# EasyEDA Pro project E33_Panel_2023.9.26.eprj, board PCB1
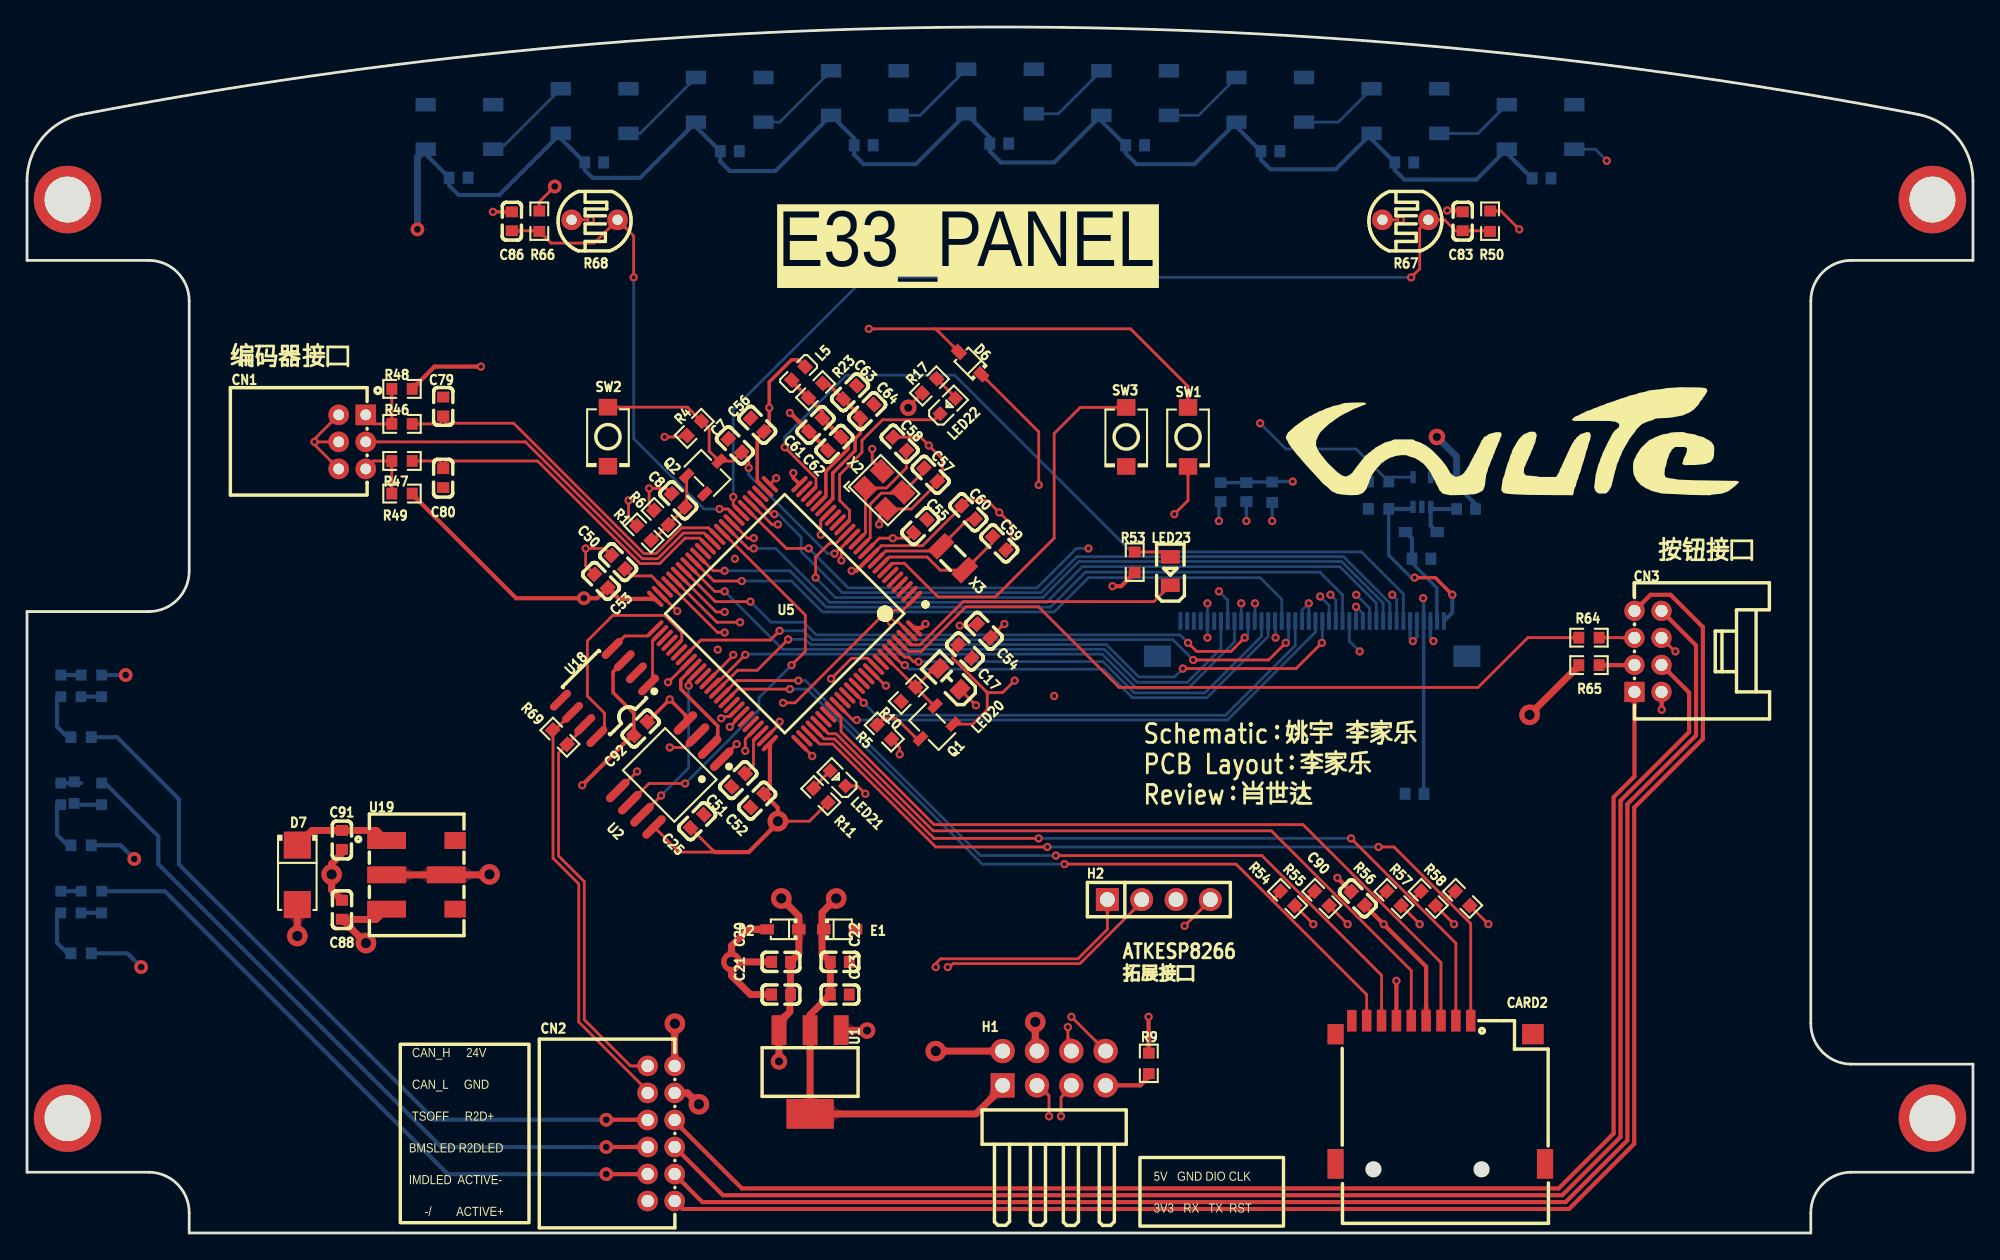
[diagram p1: board, top side]
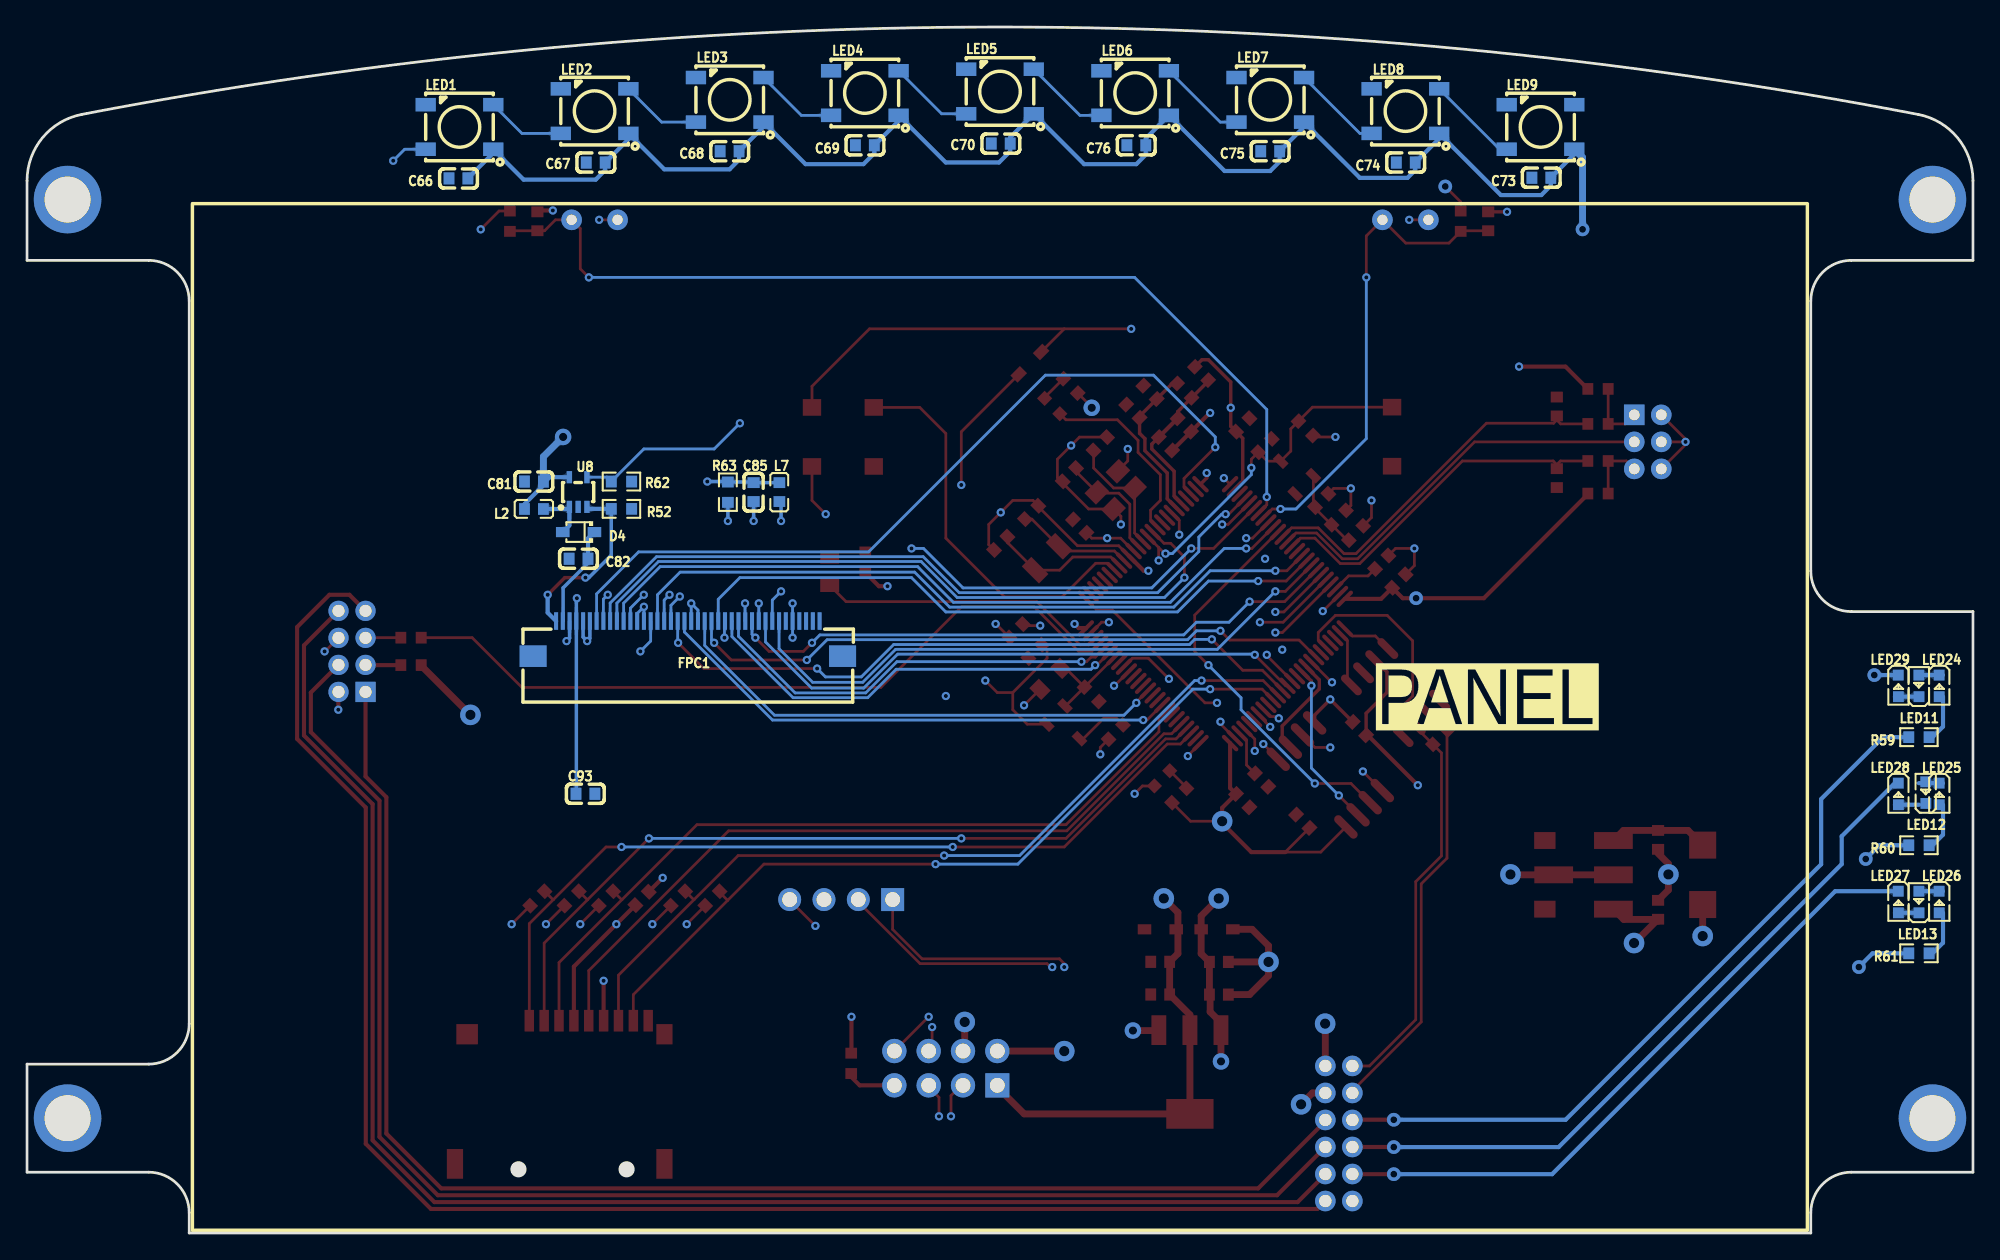
[diagram p2: board, bottom side, seen from below]

Outline 144 x 89.27 mm; copper layers: Top Layer, Inner1, Inner2, Bottom Layer. Coordinates in mm from the lower left corner of the outline.
Outline path: 0,77.89 arc(1.15,81.08) 4.06,82.8 arc(72,89.27) 139.94,82.8 arc(142.85,81.08) 144,77.89 144,72 135,72 arc(132.88,71.12) 132,69 132,15.5 arc(132.88,13.38) 135,12.5 144,12.5 144,4.5 135,4.5 arc(132.88,3.62) 132,1.5 132,0 12,0 12,1.5 arc(11.12,3.62) 9,4.5 0,4.5 0,46 9,46 arc(11.12,46.88) 12,49 12,69 arc(11.12,71.12) 9,72 0,72 0,77.89
Stack: Top Layer 0.035mm 外层铜厚1oz / Dielectric1 0.2104mm 7628 RC49% 8.6mil / Inner1 0.0152mm 内层铜厚 / Dielectric2 1.065mm 1.1mm H/HOZ 含铜 / Inner2 0.0152mm 内层铜厚 / Dielectric3 0.2104mm 7628 RC49% 8.6mil / Bottom Layer 0.035mm 外层铜厚1oz

## Design rules (mm)
template: 用户自定义配置
spacing safeClearance (default): track to track 0.152, other pairs 0.152 to 0.3
track width trackWidth (default): min 0.127, default 0.254, max 2.54
differential pair differentialPair (default): width min 0.127, default 0.254, max 2.54; gap min 0.152, default 0.152
via viaSize (default): diameter min 0.5, default 0.61, max 10; hole min 0.3, default 0.305, max 5.999

## Placement (name value [footprint] x y rotation side)
C7  100nF  [C0603]  52.39 58.29 315 top
C8  100nF  [C0603]  48.19 54.23 315 top
C17  100nF  [C0603]  69.4 43.05 135 top
C20  10uF  [C0603]  55.8 20.07 0 top
C21  100nF  [C0603]  55.8 17.65 0 top
C22  100nF  [C0603]  60.15 20.07 180 top
C23  10uF  [C0603]  60.15 17.65 180 top
C25  100nF  [C0603]  49.59 30.48 45 top
C50  2.2uF  [C0603]  43.75 49.66 315 top
C51  2.2uF  [C0603]  52.64 33.53 45 top
C52  100nF  [C0603]  54.04 32 45 top
C53  100nF  [C0603]  42.48 48.26 315 top
C54  100nF  [C0603]  70.8 44.58 135 top
C55  100nF  [C0603]  66.1 52.32 225 top
C56  100nF  [C0603]  54.04 59.82 315 top
C57  12pF  [C0603]  66.86 56.13 135 top
C58  12pF  [C0603]  64.58 58.42 315 top
C59  12pF  [C0603]  71.94 51.05 135 top
C60  12pF  [C0603]  69.66 53.34 315 top
C61  10uF  [C0603]  58.35 59.82 45 top
C62  100nF  [C0603]  59.75 58.42 45 top
C63  10uF  [C0603]  60.9 62.23 225 top
C64  100nF  [C0603]  62.16 60.83 225 top
C66  100nF  [C0603]  112.08 78.07 0 bottom
C67  100nF  [C0603]  101.92 79.24 0 bottom
C68  100nF  [C0603]  92.01 80.08 0 bottom
C69  100nF  [C0603]  82 80.52 0 bottom
C70  100nF  [C0603]  71.94 80.65 0 bottom
C73  100nF  [C0603]  31.94 78.12 180 bottom
C74  100nF  [C0603]  41.97 79.24 180 bottom
C75  100nF  [C0603]  52 80.08 180 bottom
C76  100nF  [C0603]  61.91 80.52 180 bottom
C79  10nF  [C0603]  30.8 61.18 270 top
C80  10nF  [C0603]  30.8 55.88 90 top
C81  4.7uF  [C0603]  106.49 55.63 180 bottom
C82  1uF  [C0603]  103.19 49.91 180 bottom
C83  100nF  [C0603]  106.23 74.89 270 top
C85  100nF  [C0603]  90.23 54.85 90 bottom
C86  100nF  [C0603]  35.88 74.89 270 top
C88  22uF  [C0603]  23.3 23.93 270 top
C90  100nF  [C0603]  98.49 24.77 315 top
C91  10uF  [C0603]  23.3 29.1 90 top
C92  100nF  [C0603]  45.4 37.34 225 top
C93  100nF  [C0603]  102.68 32.51 180 bottom
CARD2  TF PUSH  [TF-SMD_TF-PUSH]  104.58 10.41 0 top
CN1  M2026R-2x3P  [CONN-TH_M2026R-2X3P]  24.06 58.56 270 top
CN2  HC-PHB-2*6AW  [CONN-TH_12P-P2.00_HC-PHB-2X6AW]  46.92 7.37 270 top
CN3  HC-PHB-2*4AW  [CONN-TH_8P-P2.00_HCTL_HC-PHB-2X4AW]  119.95 43.05 90 top
D2  CESD5V0D3 ZA  [SOD-323_L1.8-W1.3-LS2.5-RD]  55.94 22.48 180 top
D4  NSR0240HT1G  [SOD-323_L1.8-W1.3-LS2.5-RD]  103.19 51.89 0 bottom
D6  1N4148WS  [SOD-323_L1.8-W1.3-LS2.5-RD]  69.78 64.39 135 top
D7  SS34  [SMA_L4.3-W2.6-LS5.2-RD]  20 26.51 270 top
E1  CESD3V3D3 YU  [SOD-323_L1.8-W1.3-LS2.5-RD]  60.13 22.48 0 top
FPC1  AFC01-S40FCA-00  [FPC-SMD_P0.50-40P_FGS-XJ-H2.0]  95.1 44 0 bottom
H1  PZ254R-12-8P  [HDR-TH_8P-P2.54-H-M-R2-C4-S2.54]  76.01 12.2 0 top
H2  PM254V-11-04-H85  [HDR-TH_4P-P2.54-V-F]  83.75 24.68 0 top
L2  4.7uH  [L0603]  106.49 53.59 180 bottom
L5  10uH  [L0603]  57.09 63.63 225 top
L7  BLM18AG601SN1D  [L0603]  88.33 54.84 90 bottom
LED1  WS2812B-B/W  [LED-SMD_4P-L5.0-W5.0-BL_TC5050RGB]  112 81.87 0 bottom
LED2  WS2812B-B/W  [LED-SMD_4P-L5.0-W5.0-BL_TC5050RGB]  102 83.05 0 bottom
LED3  WS2812B-B/W  [LED-SMD_4P-L5.0-W5.0-BL_TC5050RGB]  92 83.88 0 bottom
LED4  WS2812B-B/W  [LED-SMD_4P-L5.0-W5.0-BL_TC5050RGB]  82 84.39 0 bottom
LED5  WS2812B-B/W  [LED-SMD_4P-L5.0-W5.0-BL_TC5050RGB]  72 84.5 0 bottom
LED6  WS2812B-B/W  [LED-SMD_4P-L5.0-W5.0-BL_TC5050RGB]  62 84.39 0 bottom
LED7  WS2812B-B/W  [LED-SMD_4P-L5.0-W5.0-BL_TC5050RGB]  52 83.88 0 bottom
LED8  WS2812B-B/W  [LED-SMD_4P-L5.0-W5.0-BL_TC5050RGB]  42 83.05 0 bottom
LED9  WS2812B-B/W  [LED-SMD_4P-L5.0-W5.0-BL_TC5050RGB]  32 81.87 0 bottom
LED11  19-217/GHC-YR1S2/3T  [LED0603-RD]  4 40.5 90 bottom
LED12  NCD0603R1  [LED0603-RD_RED]  3.49 32.6 90 bottom
LED13  NCD0603R1  [LED0603-RD_RED]  4 24.5 90 bottom
LED20  17-21SYGC/S530-E3/TR8  [LED0805-RD]  68.26 41.02 135 top
LED21  NCD0603W1  [LED0603-RD]  60.01 33.66 135 top
LED22  NCD0603B1  [LED0603-RD]  68.13 61.21 45 top
LED23  17-21SURC/S530-A3/TR8  [LED0805-R-RD]  84.6 49 90 top
LED24  19-217/GHC-YR1S2/3T  [LED0603-RD]  2.5 40.5 270 bottom
LED25  NCD0603R1  [LED0603-RD_RED]  2.5 32.5 270 bottom
LED26  NCD0603R1  [LED0603-RD_RED]  2.5 24.5 270 bottom
LED27  NCD0603R1  [LED0603-RD_RED]  5.52 24.5 270 bottom
LED28  NCD0603R1  [LED0603-RD_RED]  5.52 32.5 270 bottom
LED29  19-217/GHC-YR1S2/3T  [LED0603-RD]  5.52 40.5 270 bottom
NOREF  -  [Pad_e124]  141 76.5 180 top
NOREF#2  -  [Pad_e122]  141 8.5 180 top
NOREF#3  -  [Pad_e127]  3 8.5 180 top
NOREF#4  -  [Pad_e126]  3 76.5 180 top
Q1  S8050  [SOT-23-3_L2.9-W1.6-P1.90-LS2.8-BR]  66.99 37.47 45 top
Q2  S8050  [SOT-23-3_L2.9-W1.6-P1.90-LS2.8-BR]  50.35 56.26 225 top
R1  10kΩ  [R0603]  45.66 51.82 315 top
R4  10kΩ  [R0603]  49.38 59.56 225 top
R5  100Ω  [R0603]  63.44 37.08 315 top
R6  10kΩ  [R0603]  46.92 52.96 315 top
R9  1kΩ  [R0603]  83.01 12.56 270 top
R10  10kΩ  [R0603]  65.21 39.88 45 top
R11  150Ω  [R0603]  58.74 32.39 135 top
R17  100Ω  [R0603]  66.78 62.7 45 top
R23  0Ω  [R0603]  58.35 62.36 225 top
R46  10kΩ  [R0603]  27.75 59.89 0 top
R47  10kΩ  [R0603]  27.75 57.15 180 top
R48  10kΩ  [R0603]  27.75 62.48 180 top
R49  10kΩ  [R0603]  27.75 54.74 180 top
R50  10kΩ  [R0603]  108.27 74.9 90 top
R52  5.1Ω  [R0603]  100.01 53.6 0 bottom
R53  100Ω  [R0603]  81.97 49.66 90 top
R54  10kΩ  [R0603]  93.28 24.77 315 top
R55  10kΩ  [R0603]  95.82 24.77 315 top
R56  10kΩ  [R0603]  101.15 24.77 315 top
R57  10kΩ  [R0603]  103.69 24.77 315 top
R58  10kΩ  [R0603]  106.23 24.77 315 top
R59  750Ω  [R0603]  4 36.7 180 bottom
R60  1kΩ  [R0603]  4 28.7 180 bottom
R61  1kΩ  [R0603]  4 20.7 180 bottom
R62  10kΩ  [R0603]  100.01 55.63 0 bottom
R63  10kΩ  [R0603]  92.14 54.84 270 bottom
R64  300Ω  [R0603]  115.58 44.07 0 top
R65  3kΩ  [R0603]  115.58 42.04 0 top
R66  10kΩ  [R0603]  37.91 74.9 90 top
R67  GL3516（5-10K）  [RES-TH_L5.1-W4.3-P3.40-D0.5]  102 75 90 top
R68  GL3516（5-10K）  [RES-TH_L5.1-W4.3-P3.40-D0.5]  42 75 90 top
R69  120Ω  [R0603]  39.43 36.7 315 top
SW1  TS-1088-AR02016  [SW-SMD_L3.9-W3.0-P4.45]  85.91 58.93 270 top
SW2  TS-1088-AR02016  [SW-SMD_L3.9-W3.0-P4.45]  42.99 58.95 270 top
SW3  TS-1088-AR02016  [SW-SMD_L3.9-W3.0-P4.45]  81.34 58.93 270 top
U1  AMS1117-1.8  [SOT-223_L6.7-W3.5-P2.30-BR]  57.95 11.92 90 top
U2  W25Q64JVSSIQ  [SOP-8_L5.3-W5.3-P1.27-LS8.0-BL]  47.56 33.91 135 top
U5  STM32H7B0VBT6  [LQFP-100_L14.0-W14.0-P0.50-LS16.0-BL]  56.07 45.85 135 top
U8  -  [SC-70-5_L2.1-W1.3-P0.65-LS2.1-BR]  103.22 54.85 270 bottom
U18  TJA1042T/1J  [SOIC-8_L5.0-W4.0-P1.27-LS6.0-BL]  42.73 40.01 135 top
U19  K7805MT-1000R4  [PWRM-SMD_K78XXMT-1000R4]  29.14 26.51 270 top
X2  25MHz  [OSC-SMD_4P-L3.2-W2.5-BL]  63.44 54.99 315 top
X3  32.768kHz  [FC-135R_L3.2-W1.5]  68.51 49.95 315 top

## Footprints (pads in the part's own frame, mm; a bottom-side part is the same pattern mirrored in y, then rotated)
C0603
  rect 0.8x0.9 smd: 1(-0.7,0) 2(0.7,0)
CONN-TH_8P-P2.00_HCTL_HC-PHB-2X4AW
  rect 1.5x1.5 hole 0.9: 1(-3,1)
  round 1.5 hole 0.9: 2(-3,-1) 3(-1,1) 4(-1,-1) 5(1,1) 6(1,-1) 7(3,1) 8(3,-1)
CONN-TH_12P-P2.00_HC-PHB-2X6AW
  round 1.524 hole 0.914: 1(-5,1) 2(-5,-1) 3(-3,1) 4(-3,-1) 5(-1,1) 6(-1,-1) 7(1,1) 8(1,-1) 9(3,1) 10(3,-1) 11(5,1) 12(5,-1)
CONN-TH_M2026R-2X3P
  rect 1.524x1.524 hole 0.8: 1(-2,1)
  round 1.524 hole 0.8: 2(0,1) 3(2,1) 4(2,-1) 5(0,-1) 6(-2,-1)
FC-135R_L3.2-W1.5
  rect 1x1.8 smd: 1(-1.25,0) 2(1.25,0)
FPC-SMD_P0.50-40P_FGS-XJ-H2.0
  rect 0.3x1.3 smd: 1(9.75,-1.3) 2(9.25,-1.3) 3(8.75,-1.3) 4(8.25,-1.3) 5(7.75,-1.3) 6(7.25,-1.3) 7(6.75,-1.3) 8(6.25,-1.3) 9(5.75,-1.3) 10(5.25,-1.3) 11(4.75,-1.3) 12(4.25,-1.3) 13(3.75,-1.3) 14(3.25,-1.3) 15(2.75,-1.3) 16(2.25,-1.3) 17(1.75,-1.3) 18(1.25,-1.3) 19(0.75,-1.3) 20(0.25,-1.3) 21(-0.25,-1.3) 22(-0.75,-1.3) 23(-1.25,-1.3) 24(-1.75,-1.3) 25(-2.25,-1.3) 26(-2.75,-1.3) 27(-3.25,-1.3) 28(-3.75,-1.3) 29(-4.25,-1.3) 30(-4.75,-1.3) 31(-5.25,-1.3) 32(-5.75,-1.3) 33(-6.25,-1.3) 34(-6.75,-1.3) 35(-7.25,-1.3) 36(-7.75,-1.3) 37(-8.25,-1.3) 38(-8.75,-1.3) 39(-9.25,-1.3) 40(-9.75,-1.3)
  rect 2x1.6 smd: 41(11.45,1.3) 42(-11.45,1.3)
HDR-TH_4P-P2.54-V-F
  rect 1.7x1.7 hole 1.1: 1(-3.81,0)
  round 1.7 hole 1.1: 2(-1.27,0) 3(1.27,0) 4(3.81,0)
HDR-TH_8P-P2.54-H-M-R2-C4-S2.54
  rect 1.778x1.8 hole 1.1: 1(-3.81,-1.27)
  round 1.8 hole 1.1: 2(-3.81,1.27) 3(-1.27,-1.27) 4(-1.27,1.27) 5(1.27,-1.27) 6(1.27,1.27) 7(3.81,-1.27) 8(3.81,1.27)
L0603
  rect 0.8x0.864 smd: 1(-0.7,0) 2(0.7,0)
LED0603-RD
  rect 0.8x0.8 smd: 1(-0.799,-0.004) 2(0.799,0.004)
LED0603-RD_RED
  rect 0.8x0.8 smd: 1(-0.799,-0.004) 2(0.799,0.004)
LED0805-R-RD
  rect 1x1.399 smd: 1(1.05,0) 2(-1.05,0)
LED0805-RD
  rect 1x1.25 smd: 1(-1.1,0) 2(1.1,0)
LED-SMD_4P-L5.0-W5.0-BL_TC5050RGB
  rect 1.5x1 smd: 1(-2.5,1.65) 2(-2.5,-1.65) 3(2.5,-1.65) 4(2.5,1.65)
LQFP-100_L14.0-W14.0-P0.50-LS16.0-BL
  oval 0.3x1.6 smd: 1(-6,-7.55) 2(-5.5,-7.55) 3(-5,-7.55) 4(-4.5,-7.55) 5(-4,-7.55) 6(-3.5,-7.55) 7(-3,-7.55) 8(-2.5,-7.55) 9(-2,-7.55) 10(-1.5,-7.55) 11(-1,-7.55) 12(-0.5,-7.55) 13(0,-7.55) 14(0.5,-7.55) 15(1,-7.55) 16(1.5,-7.55) 17(2,-7.55) 18(2.5,-7.55) 19(3,-7.55) 20(3.5,-7.55) 21(4,-7.55) 22(4.5,-7.55) 23(5,-7.55) 24(5.5,-7.55) 25(6,-7.55) 51(6,7.55) 52(5.5,7.55) 53(5,7.55) 54(4.5,7.55) 55(4,7.55) 56(3.5,7.55) 57(3,7.55) 58(2.5,7.55) 59(2,7.55) 60(1.5,7.55) 61(1,7.55) 62(0.5,7.55) 63(0,7.55) 64(-0.5,7.55) 65(-1,7.55) 66(-1.5,7.55) 67(-2,7.55) 68(-2.5,7.55) 69(-3,7.55) 70(-3.5,7.55) 71(-4,7.55) 72(-4.5,7.55) 73(-5,7.55) 74(-5.5,7.55) 75(-6,7.55)
  oval 1.6x0.3 smd: 26(7.55,-6) 27(7.55,-5.5) 28(7.55,-5) 29(7.55,-4.5) 30(7.55,-4) 31(7.55,-3.5) 32(7.55,-3) 33(7.55,-2.5) 34(7.55,-2) 35(7.55,-1.5) 36(7.55,-1) 37(7.55,-0.5) 38(7.55,0) 39(7.55,0.5) 40(7.55,1) 41(7.55,1.5) 42(7.55,2) 43(7.55,2.5) 44(7.55,3) 45(7.55,3.5) 46(7.55,4) 47(7.55,4.5) 48(7.55,5) 49(7.55,5.5) 50(7.55,6) 76(-7.55,6) 77(-7.55,5.5) 78(-7.55,5) 79(-7.55,4.5) 80(-7.55,4) 81(-7.55,3.5) 82(-7.55,3) 83(-7.55,2.5) 84(-7.55,2) 85(-7.55,1.5) 86(-7.55,1) 87(-7.55,0.5) 88(-7.55,0) 89(-7.55,-0.5) 90(-7.55,-1) 91(-7.55,-1.5) 92(-7.55,-2) 93(-7.55,-2.5) 94(-7.55,-3) 95(-7.55,-3.5) 96(-7.55,-4) 97(-7.55,-4.5) 98(-7.55,-5) 99(-7.55,-5.5) 100(-7.55,-6)
OSC-SMD_4P-L3.2-W2.5-BL
  rect 1.4x1.2 smd: 1(-1.1,-0.875) 2(1.1,-0.875) 3(1.1,0.875) 4(-1.1,0.875)
Pad_e122
  round 5 hole 3.4: 101(0,0)
Pad_e124
  round 5 hole 3.4: 102(0,0)
Pad_e126
  round 5 hole 3.4: 103(0,0)
Pad_e127
  round 5 hole 3.4: 104(0,0)
PWRM-SMD_K78XXMT-1000R4
  rect 1.25x2.87 smd: 1(-2.54,-2.538) 2(0,-2.538) 3(2.54,-2.538) 5(0,1.883)
  rect 1.25x1.58 smd: 4(2.54,2.538) 6(-2.54,2.538)
R0603
  rect 0.806x0.864 smd: 1(-0.753,0) 2(0.753,0)
RES-TH_L5.1-W4.3-P3.40-D0.5
  round 1.524 hole 0.762: 1(0,1.7) 2(0,-1.7)
SC-70-5_L2.1-W1.3-P0.65-LS2.1-BR
  rect 0.9x0.4 smd: 1(1.1,-0.65) 2(1.1,0) 3(1.1,0.65) 4(-1.1,0.65) 5(-1.1,-0.65)
SMA_L4.3-W2.6-LS5.2-RD
  rect 2x2 smd: 1(-2.2,0) 2(2.2,0)
SOD-323_L1.8-W1.3-LS2.5-RD
  rect 1x0.75 smd: 1(-1.173,0) 2(1.173,0)
SOIC-8_L5.0-W4.0-P1.27-LS6.0-BL
  oval 0.569x1.95 smd: 1(-1.905,-2.705) 2(-0.635,-2.705) 3(0.635,-2.705) 4(1.905,-2.705) 5(1.905,2.705) 6(0.635,2.705) 7(-0.635,2.705) 8(-1.905,2.705)
SOP-8_L5.3-W5.3-P1.27-LS8.0-BL
  oval 0.609x2.204 smd: 1(-1.905,-3.542) 2(-0.635,-3.542) 3(0.635,-3.542) 4(1.905,-3.542) 5(1.905,3.542) 6(0.635,3.542) 7(-0.635,3.542) 8(-1.905,3.542)
SOT-23-3_L2.9-W1.6-P1.90-LS2.8-BR
  rect 1.07x0.6 smd: 1(1.235,-0.95) 2(1.235,0.95) 3(-1.235,0)
SOT-223_L6.7-W3.5-P2.30-BR
  rect 2.2x1.1 smd: 1(3.099,-2.3) 2(3.099,0) 3(3.099,2.3)
  rect 2.2x3.5 smd: 4(-3.099,0)
SW-SMD_L3.9-W3.0-P4.45
  rect 1.23x1.36 smd: 1(-2.185,0) 2(2.185,0)
TF-SMD_TF-PUSH
  rect 0.7x1.6 smd: 1(2.25,5.3) 2(1.15,5.3) 3(0.05,5.3) 4(-1.05,5.3) 5(-2.15,5.3) 6(-3.25,5.3) 7(-4.35,5.3) 8(-5.45,5.3) CD(-6.55,5.3)
  rect 1.2x1.5 smd: 10(-7.75,4.3)
  rect 1.2x2.2 smd: 11(-7.75,-5.3) 12(7.75,-5.3)
  rect 1.6x1.5 smd: 13(6.85,4.3)

## Nets
3.3V: C22.2 C23.2 C25.1 C52.2 C53.2 C54.2 C55.2 C56.2 C90.2 CARD2.4 E1.1 H1.1 H2.4 L5.1 L7.1 R4.2 R5.2 R11.1 R17.1 R48.1 R49.1 R50.2 R53.1 R54.2 R55.2 R56.2 R57.2 R58.2 R66.2 SW1.2 U1.2 U1.4 U2.8 U5.11 U5.27 U5.50 U5.75 U5.100
5V: C20.2 C21.2 C66.1 C67.1 C68.1 C69.1 C70.1 C73.2 C74.2 C75.2 C76.2 C81.2 C88.2 C92.2 D2.1 H1.2 L2.1 LED1.1 LED2.1 LED3.1 LED4.1 LED5.1 LED6.1 LED7.1 LED8.1 LED9.1 U1.3 U8.5 U18.3 U19.3
24V: CN2.1 D7.2 R60.1 R61.1 R65.1
GND: C7.1 C8.1 C17.1 C20.1 C21.1 C22.1 C23.1 C25.2 C50.1 C51.1 C52.1 C53.1 C54.1 C55.1 C56.1 C57.1 C58.1 C59.1 C60.1 C61.1 C62.1 C63.1 C64.1 C66.2 C67.2 C68.2 C69.2 C70.2 C73.1 C74.1 C75.1 C76.1 C79.1 C80.1 C81.1 C82.1 C83.1 C85.1 C86.1 C88.1 C90.1 C91.1 C92.1 C93.2 CARD2.6 CARD2.10 CARD2.11 CARD2.12 CARD2.13 CN1.4 CN1.5 CN1.6 CN2.3 CN3.2 CN3.6 D2.2 E1.2 FPC1.3 FPC1.5 FPC1.6 FPC1.13 FPC1.14 FPC1.21 FPC1.22 FPC1.29 FPC1.36 H1.4 H2.3 LED1.3 LED2.3 LED3.3 LED4.3 LED5.3 LED6.3 LED7.3 LED8.3 LED9.3 LED20.1 LED21.1 LED29.1 NOREF.102 NOREF#2.101 NOREF#3.104 NOREF#4.103 Q2.2 R6.1 R10.1 R52.1 R62.1 R67.1 R68.1 SW2.2 SW3.2 U1.1 U2.4 U5.10 U5.19 U5.26 U5.49 U5.74 U5.99 U8.2 U18.2 U19.2 U19.5 X2.2 X2.4
VDDA: C61.2 C62.2 L5.2 R23.2 U5.21
ACTIVE+: CN2.11 CN3.7
ACTIVE-: CN2.9 CN3.8
ADC1_INP4_PC4: C83.2 R50.1 R67.2 U5.32
ADC1_INP8_PC5: C86.2 R66.1 R68.2 U5.33
BMS_LIGHT: CN2.8 LED28.1
BOOT0: LED20.2 Q1.2 R10.2 U5.94
BUTTONLED_PE0: R64.1 U5.97
CAN_H: CN2.2 R69.2 U18.7
CAN_L: CN2.4 R69.1 U18.6
FDCAN2_RX: U5.51 U18.4
FDCAN2_TX: U5.52 U18.1
GPIO_INPUT_PE7: C80.2 R47.1 U5.39
GPIO_INPUT_PE8: CN1.2 U5.38
GPIO_INPUT_PE9: C79.2 R46.2 U5.37
GPIO_OUTPUT_PD8: U5.55 U18.8
IMD_LIGHT: CN2.10 LED27.1
KEYPC13: SW3.1 U5.7
L3.3V: C85.2 C93.1 FPC1.4 L7.2 R63.1
LED_PC1: LED22.1 U5.16
LED_PE1: LED23.2 U5.98
LTDC_B2: FPC1.23 U5.87
LTDC_B3: FPC1.24 U5.57
LTDC_B4: FPC1.25 U5.42
LTDC_B5: FPC1.26 U5.25
LTDC_B6: FPC1.27 U5.95
LTDC_B7: FPC1.28 U5.96
LTDC_BL: R62.2 U5.62 U8.4
LTDC_CLK: FPC1.30 U5.44
LTDC_DE: FPC1.34 U5.43
LTDC_G2: FPC1.15 U5.30
LTDC_G3: FPC1.16 U5.41
LTDC_G4: FPC1.17 U5.46
LTDC_G5: FPC1.18 U5.47
LTDC_G6: FPC1.19 U5.64
LTDC_G7: FPC1.20 U5.84
LTDC_HS: FPC1.32 U5.63
LTDC_R2: FPC1.7 U5.23
LTDC_R3: FPC1.8 U5.34
LTDC_R4: FPC1.9 U5.29
LTDC_R5: FPC1.10 U5.15
LTDC_R6: FPC1.11 U5.35
LTDC_R7: FPC1.12 U5.45
LTDC_VS: FPC1.33 U5.31
OS_25M_IN: C57.2 U5.12 X2.3
OS_25M_OUT: C58.2 U5.13 X2.1
OS_32K_IN: C59.2 U5.8 X3.2
OS_32K_OUT: C60.2 U5.9 X3.1
OSPI_BK1_IO0_PD11: U2.5 U5.58
OSPI_BK1_IO1_PD12: U2.2 U5.59
OSPI_BK1_IO2_PE2: U2.3 U5.1
OSPI_BK1_IO3_PD13: U2.7 U5.60
OSPI_BK1_NCS_PB6: U2.1 U5.92
OSPI_CLK_PB2: U2.6 U5.36
R2D+: CN2.5 CN3.1
R2D_LIGHT: CN2.7 CN3.4
RST: C7.2 Q2.3 R4.1 R9.1 SW2.1 U5.14
SDIO_CLK_PC12: CARD2.5 U5.80
SDIO_CMD_PD2: CARD2.3 R56.1 U5.83
SDIO_D0_PC8: CARD2.7 R55.1 U5.65
SDIO_D1_PC9: CARD2.8 R54.1 U5.66
SDIO_D2_PC10: CARD2.1 R58.1 U5.78
SDIO_D3_PC11: CARD2.2 R57.1 U5.79
SWCLKPA14: H1.8 U5.76
SWDIOPA13: H1.6 U5.72
TIM3_CH2: LED1.4 U5.91
TS_OFF_H: CN2.6 R59.1
USART1-RXPA10: H1.3 H2.2 U5.69
USART1-TXPA9: H1.5 H2.1 U5.68
VLED+: C82.2 D4.1 FPC1.2
VLED-: FPC1.1 R52.2 U8.3
VREF: C63.2 C64.2 R23.1 U5.20
$1N3072: D6.2 R1.1 SW1.1
$1N3073: C8.2 Q2.1 R1.2 R6.2
$1N3080: C17.2 D6.1 Q1.1
$1N3093: LED21.2 R11.2
$1N3094: LED22.2 R17.2
$1N3180: C51.2 U5.73
$1N3181: C50.2 U5.48
$1N3236: FPC1.31 R63.2
$1N3252: LED4.2 LED5.4
$1N3253: LED3.2 LED4.4
$1N3254: LED2.2 LED3.4
$1N3255: LED1.2 LED2.4
$1N3256: LED6.2 LED7.4
$1N3257: LED7.2 LED8.4
$1N3330: LED23.1 R53.2
$1N3457: LED8.2 LED9.4
$1N3464: LED5.2 LED6.4
$1N107193: CN3.5 R64.2
$1N107203: CN3.3 R65.2
$1N160553: H1.7 R9.2
$1N161135: D4.2 L2.2 U8.1